# EasyEDA Pro project kuafu01_030内部老化方案_4.eprj, board PCB4 (continued)
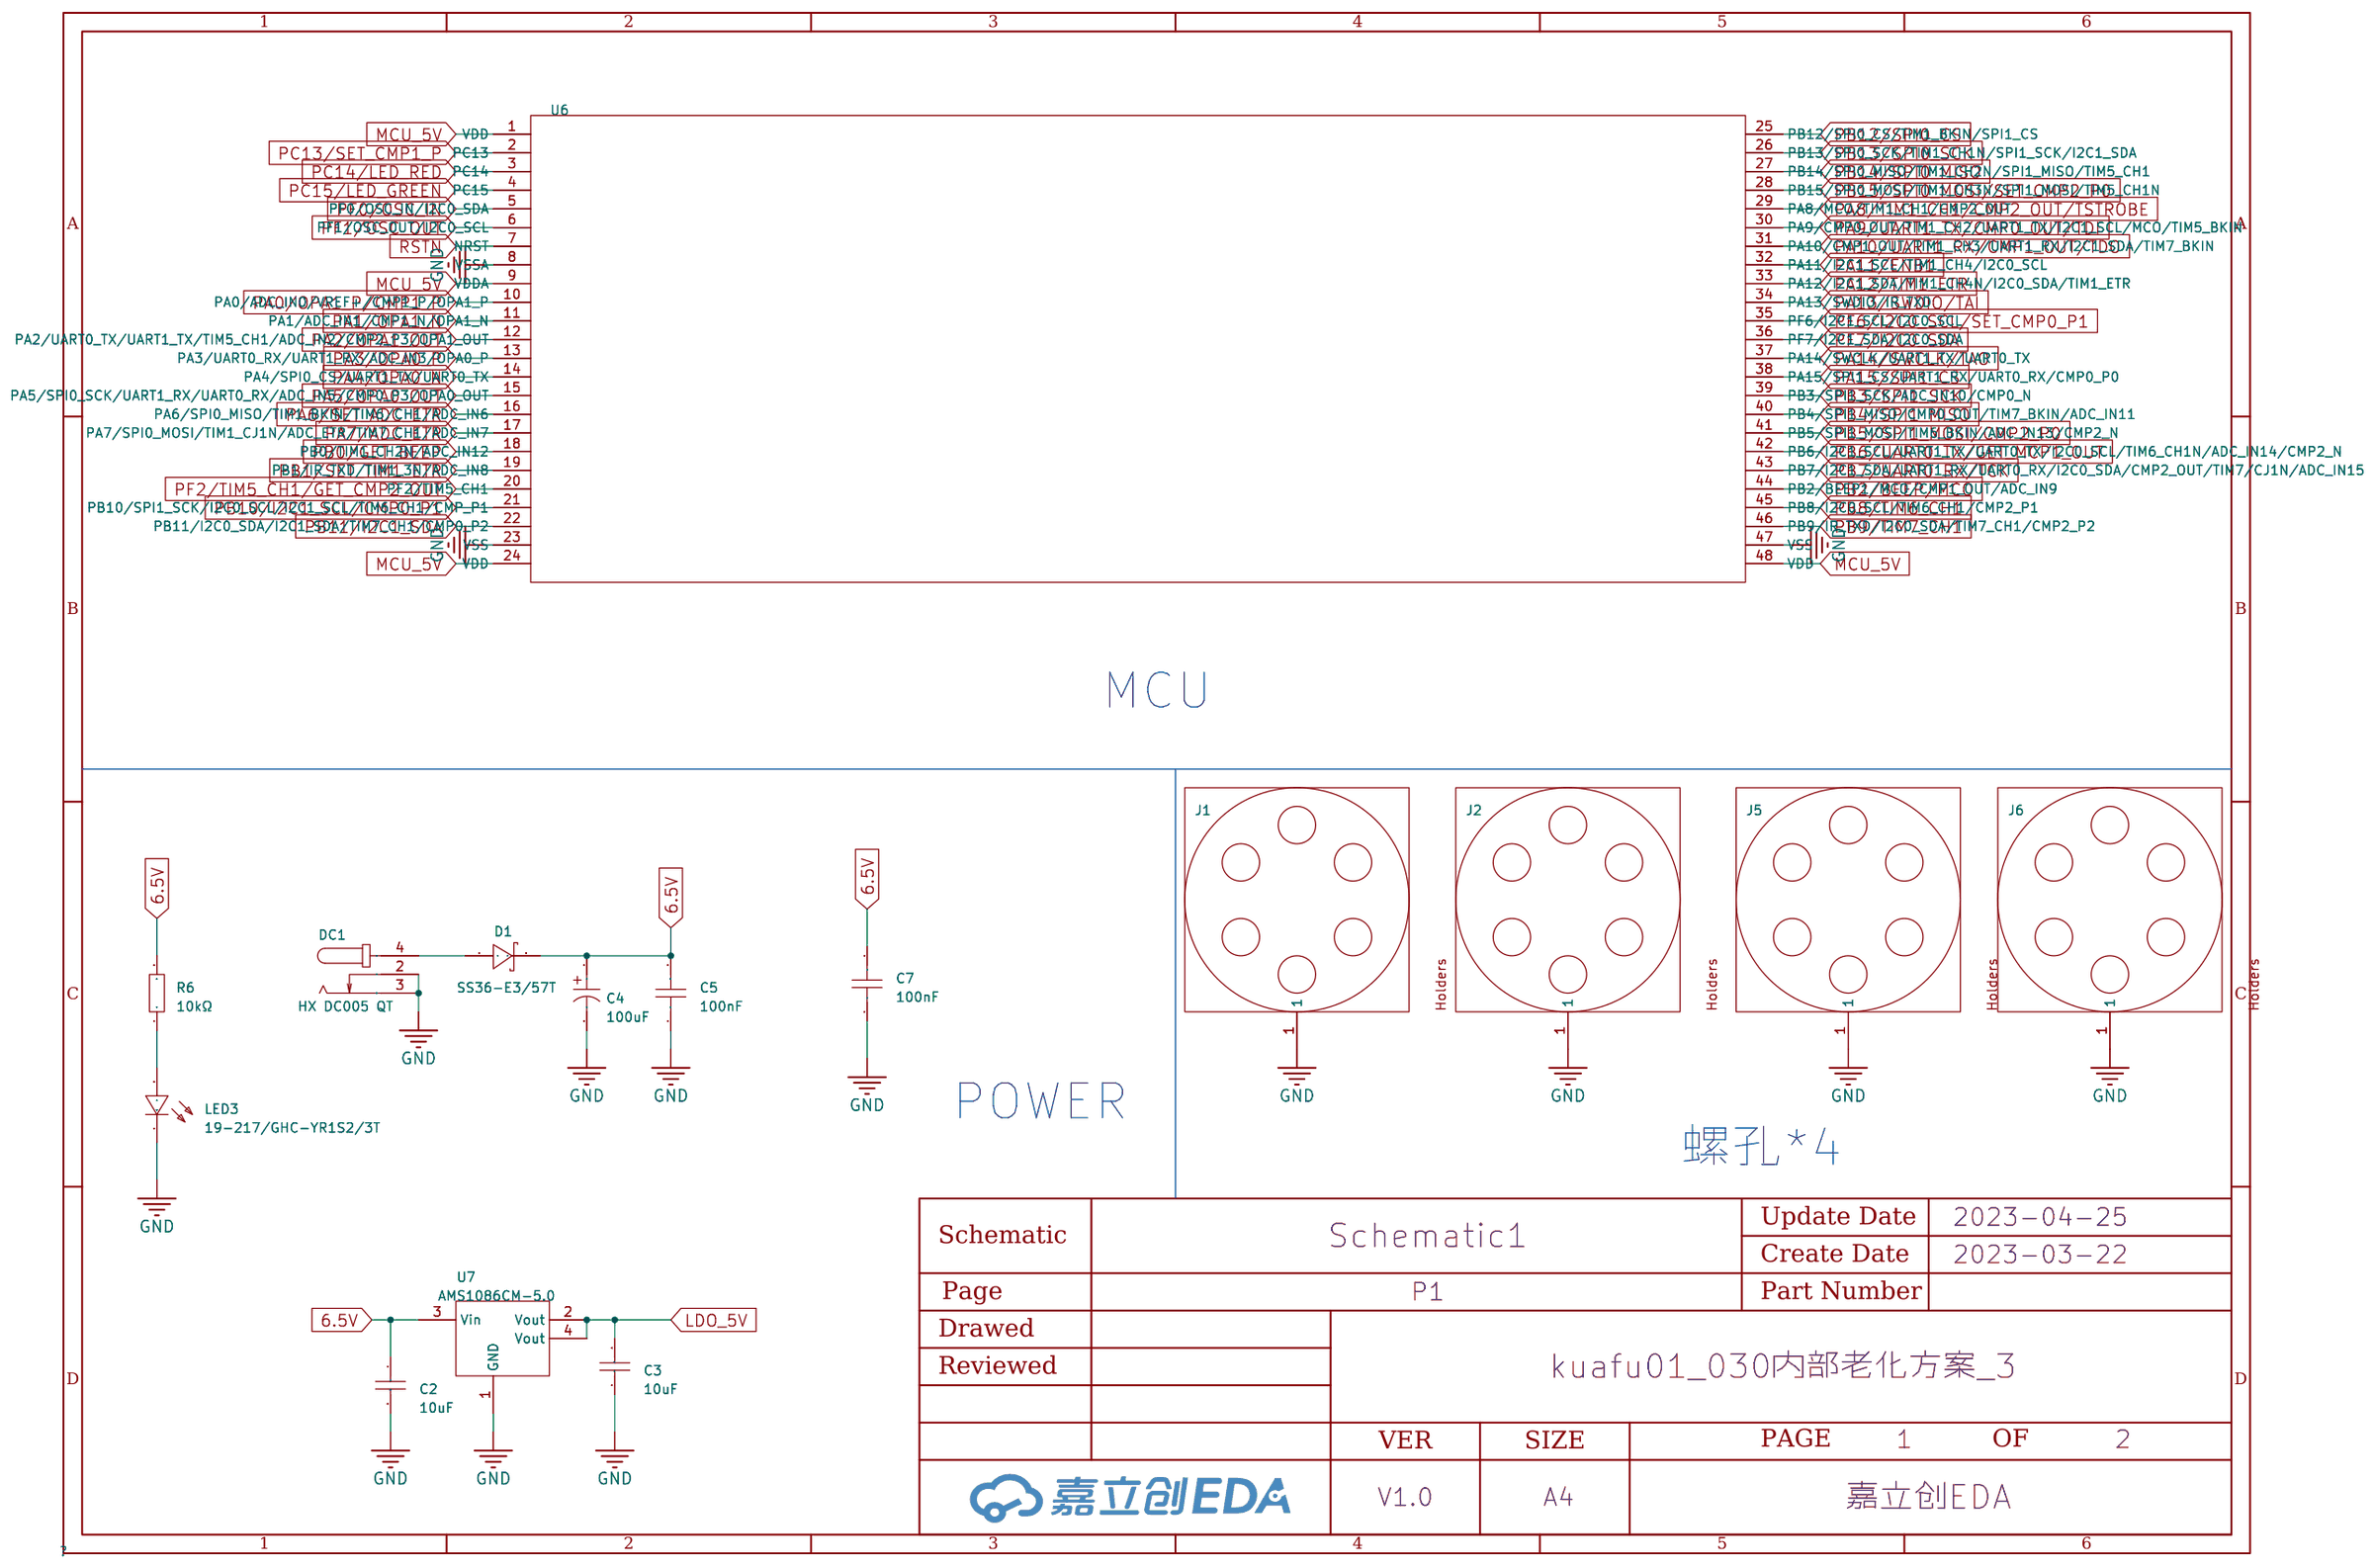
[diagram p0: P1]
## Routing (per net, layer and track width the routed paths; a pad name or vN(x,y) marks a point on that pad's centre or on a via; arc(x,y) is an arc through that point) (continued)
LDO_5V: length 2513.2
  Top Layer w0.5: H10.2 14.73,113.03 ; 14.73,113.03 62.99,113.03 65.28,110.74 H10#20.2 ; 14.73,113.03 1.53,113.03 ; 1.52,225.88 1.52,255.52 9.4,263.4 14.73,263.4 ; 1.52,225.88 1.52,188.18 ; 1.52,225.88 1.6,225.81 14.73,225.81 ; 1.52,150.62 1.52,188.18 ; 1.52,150.62 14.73,150.62 ; 1.52,150.62 1.52,75.43 ; 1.52,188.18 1.56,188.21 14.73,188.21 ; H10#27.2 216.92,263.4 ; 216.92,263.4 168.15,263.4 166.37,261.62 H10#26.2 ; 216.92,263.4 254.76,263.4 257.81,260.35 257.81,225.79 ; H10#12.2 115.82,185.93 113.54,188.21 65.28,188.21 ; 216.92,225.81 257.79,225.81 257.81,225.79 ; 216.92,225.81 H10#30.2 ; 216.92,225.81 167.64,225.81 166.37,224.54 H10#32.2 ; 216.92,37.59 253.75,37.59 257.81,41.66 257.81,75.45 ; 216.92,37.59 H10#24.2 ; 216.92,37.59 156.97,37.59 153.16,33.78 153.16,17.89 C3#2.2 153.06,17.78 U7#2.4 U7#2.2 ; H10#31.2 115.82,223.27 113.28,225.81 65.28,225.81 ; 216.92,75.44 257.8,75.44 257.81,75.45 ; 216.92,75.44 166.37,75.44 ; 216.92,75.44 H10#17.2 ; H10#10.2 216.92,188.21 ; 216.92,188.21 168.66,188.21 166.37,185.93 H10#13.2 ; 216.92,188.21 257.78,188.21 257.81,188.18 ; 14.73,37.85 7.11,37.85 1.52,43.43 1.52,75.43 ; 14.73,37.85 H10#23.2 ; 14.73,37.85 117.09,37.85 123.44,31.5 123.44,17.61 C3.2 123.46,17.57 U7.2 ; 216.92,113.03 257.78,113.03 257.81,113 ; 216.92,113.03 166.37,113.03 ; 216.92,113.03 H10#19.2 ; H10#3.2 65.28,263.4 ; 65.28,263.4 14.73,263.4 ; 65.28,263.4 113.54,263.4 115.82,261.11 H10#14.2 ; 166.37,75.44 118.11,75.44 115.82,73.15 H10#15.2 ; 166.37,75.44 H10#18.2 ; H10#21.2 115.82,111.51 117.35,113.03 166.37,113.03 ; 166.37,150.62 118.11,150.62 115.82,148.34 H10#6.2 ; 166.37,150.62 216.92,150.62 ; 166.37,150.62 H10#9.2 ; 14.73,75.44 1.54,75.44 1.52,75.43 ; 14.73,75.44 H10#2.2 ; 14.73,75.44 61.72,75.44 65.28,71.88 H10#16.2 ; 166.37,113.03 H10#22.2 ; 14.73,150.62 H10#5.2 ; 14.73,150.62 63.5,150.62 65.28,148.84 H10#7.2 ; 257.81,113 257.81,75.45 ; 257.81,113 257.81,150.5 ; 257.81,225.79 257.81,188.18 ; 14.73,188.21 H10#4.2 ; 14.73,188.21 65.28,188.21 ; 257.81,188.18 257.81,150.5 ; 257.81,150.5 257.68,150.62 216.92,150.62 ; H10#11.2 65.28,188.21 ; H10#29.2 14.73,225.81 ; 14.73,225.81 65.28,225.81 ; H10#28.2 65.28,225.81 ; 216.92,150.62 H10#8.2 ; 14.73,263.4 H10#25.2
MCU_5V: length 2294.3
  Top Layer w0.28: v2(136.25,81.65) 136.25,82.97 135.92,83.29 U6#19.24 ; v2(35.15,156.83) 35.15,158.15 34.83,158.47 U6#9.24 ; U6#3.48 26.55,130.81 24.84,130.81 ; 127.73,86.24 126.77,86.24 v2(125.93,85.4) ; 24.84,55.63 24.84,55.62 v2(24.84,53.19) 25.24,53.19 25.79,52.65 26.63,52.65 ; 24.84,55.63 26.55,55.63 U6#14.48 ; 24.84,55.63 H9#2.2 ; U6#7.24 186.47,120.88 186.79,120.56 v2(186.79,119.24) ; U6#6.48 228.74,168.4 227.02,168.4 ; 127.73,127.83 126.88,127.83 126.33,128.38 v2(125.94,128.38) 125.94,130.81 125.93,130.81 ; 176.48,93.22 176.48,93.21 v2(176.48,90.79) 176.88,90.79 177.42,90.24 U6#21.1 ; 176.48,93.22 H9#22.2 ; 176.48,93.22 178.19,93.22 U6#21.48 ; 75.38,168.4 75.39,168.4 v2(75.39,165.97) 75.79,165.97 76.33,165.42 U6#11.1 ; 75.38,168.4 77.1,168.4 U6#11.48 ; 75.38,168.4 H9#10.2 ; v2(237.34,156.83) 237.34,158.15 237.01,158.47 U6#6.24 ; v2(125.93,47.8) 126.77,48.65 127.73,48.65 ; v2(136.25,232.01) 136.25,233.33 135.92,233.66 U6#12.24 ; U6#5.24 85.38,120.88 85.7,120.56 v2(85.7,119.24) ; v2(227.02,122.99) 227.86,123.83 228.82,123.83 ; U6#30.48 127.65,205.99 125.93,205.99 ; 75.38,55.63 75.39,55.62 v2(75.39,53.19) 75.79,53.19 76.33,52.65 U6#16.1 ; 75.38,55.63 77.1,55.63 U6#16.48 ; 75.38,55.63 H9#16.2 ; 75.38,243.59 H9#3.2 ; 75.38,243.59 75.39,243.58 v2(75.39,241.15) 75.79,241.15 76.33,240.61 U6.1 ; 75.38,243.59 77.1,243.59 U6.48 ; 127.73,236.61 126.77,236.61 v2(125.93,235.76) ; 127.73,90.24 126.88,90.24 126.33,90.79 v2(125.94,90.79) 125.94,93.21 125.93,93.22 ; U6#4.48 228.74,130.81 227.02,130.81 ; U6#20.48 26.55,93.22 24.84,93.22 ; 125.93,55.63 H9#15.2 ; 125.93,55.63 127.65,55.63 U6#13.48 ; 125.93,55.63 125.94,55.62 v2(125.94,53.19) 126.33,53.19 126.88,52.65 127.73,52.65 ; 227.02,93.22 H9#18.2 ; 227.02,93.22 228.74,93.22 U6#17.48 ; 227.02,93.22 227.03,93.21 v2(227.03,90.79) 227.42,90.79 227.97,90.24 228.82,90.24 ; U6#2.24 135.92,120.88 136.25,120.56 v2(136.25,119.24) ; U6#21.9 177.32,86.24 v2(176.47,85.4) ; U6#18.24 186.47,45.7 186.79,45.37 v2(186.79,44.05) ; v2(85.7,194.42) 85.7,195.74 85.38,196.07 U6#29.24 ; 227.02,18.03 228.74,18.03 U6#24.48 ; 227.02,18.03 H9#24.2 ; 227.02,18.03 227.03,18.03 v2(227.03,15.6) 227.42,15.6 227.97,15.06 228.82,15.06 ; 176.48,55.63 176.48,55.62 v2(176.48,53.19) 176.88,53.19 177.42,52.65 U6#18.1 ; 176.48,55.63 H9#20.2 ; 176.48,55.63 178.19,55.63 U6#18.48 ; U6#7.9 177.32,123.83 v2(176.47,122.99) ; 228.82,11.06 227.86,11.06 v2(227.02,10.21) ; 24.84,93.22 24.84,93.21 v2(24.84,90.79) 25.24,90.79 25.79,90.24 26.63,90.24 ; 24.84,93.22 H9.2 ; 24.84,205.99 26.55,205.99 U6#31.48 ; 24.84,205.99 H9#29.2 ; 24.84,205.99 24.84,205.99 v2(24.84,203.56) 25.24,203.56 25.79,203.02 26.63,203.02 ; U6#7.1 177.42,127.83 176.88,128.38 v2(176.48,128.38) 176.48,130.81 176.48,130.81 ; U6#27.48 26.55,243.59 24.84,243.59 ; U6#11.24 85.38,158.47 85.7,158.15 v2(85.7,156.83) ; v2(125.93,160.58) 126.77,161.42 127.73,161.42 ; 75.38,93.22 H9#19.2 ; 75.38,93.22 77.1,93.22 U6#22.48 ; 75.38,93.22 75.39,93.21 v2(75.39,90.79) 75.79,90.79 76.33,90.24 U6#22.1 ; v2(227.02,85.4) 227.86,86.24 228.82,86.24 ; U6#29.1 76.33,203.02 75.79,203.56 v2(75.39,203.56) 75.39,205.99 75.38,205.99 ; U6#30.24 135.92,196.07 136.25,195.74 v2(136.25,194.42) ; 24.84,243.59 24.84,243.58 v2(24.84,241.15) 25.24,241.15 25.79,240.61 26.63,240.61 ; 24.84,243.59 H9#25.2 ; 125.93,205.99 125.94,205.99 v2(125.94,203.56) 126.33,203.56 126.88,203.02 127.73,203.02 ; 125.93,205.99 H9#31.2 ; 24.84,168.4 H9#4.2 ; 24.84,168.4 26.55,168.4 U6#9.48 ; 24.84,168.4 24.84,168.4 v2(24.84,165.97) 25.24,165.97 25.79,165.42 26.63,165.42 ; v2(24.83,47.8) 25.68,48.65 26.63,48.65 ; 176.48,130.81 H9#11.2 ; 176.48,130.81 178.19,130.81 U6#7.48 ; v2(237.34,232.01) 237.34,233.33 237.01,233.66 U6#26.24 ; v2(227.02,235.76) 227.86,236.61 228.82,236.61 ; v2(35.15,194.42) 35.15,195.74 34.83,196.07 U6#31.24 ; U6#13.24 135.92,45.7 136.25,45.37 v2(136.25,44.05) ; 228.82,240.61 227.97,240.61 227.42,241.15 v2(227.03,241.15) 227.03,243.58 227.02,243.59 ; U6#28.24 237.01,196.07 237.34,195.74 v2(237.34,194.42) ; U6#16.24 85.38,45.7 85.7,45.37 v2(85.7,44.05) ; v2(24.83,160.58) 25.68,161.42 26.63,161.42 ; 125.93,243.59 127.65,243.59 U6#12.48 ; 125.93,243.59 125.94,243.58 v2(125.94,241.15) 126.33,241.15 126.88,240.61 127.73,240.61 ; 125.93,243.59 H9#14.2 ; U6#5.9 76.22,123.83 v2(75.38,122.99) ; U6#10.1 177.42,165.42 176.88,165.97 v2(176.48,165.97) 176.48,168.4 176.48,168.4 ; U6#32.9 177.32,199.02 v2(176.47,198.17) ; 227.02,130.81 H9#8.2 ; 227.02,130.81 227.03,130.81 v2(227.03,128.38) 227.42,128.38 227.97,127.83 228.82,127.83 ; v2(227.02,47.8) 227.86,48.65 228.82,48.65 ; 24.84,130.81 24.84,130.81 v2(24.84,128.38) 25.24,128.38 25.79,127.83 26.63,127.83 ; 24.84,130.81 H9#5.2 ; 227.02,55.63 227.03,55.62 v2(227.03,53.19) 227.42,53.19 227.97,52.65 228.82,52.65 ; 227.02,55.63 H9#17.2 ; 227.02,55.63 228.74,55.63 U6#15.48 ; 227.02,243.59 H9#27.2 ; 227.02,243.59 228.74,243.59 U6#26.48 ; U6#25.24 186.47,233.66 186.79,233.33 v2(186.79,232.01) ; 75.38,205.99 H9#28.2 ; 75.38,205.99 77.1,205.99 U6#29.48 ; U6#5.1 76.33,127.83 75.79,128.38 v2(75.39,128.38) 75.39,130.81 75.38,130.81 ; v2(125.93,198.17) 126.77,199.02 127.73,199.02 ; v2(75.38,85.4) 76.22,86.24 U6#22.9 ; 75.38,130.81 77.1,130.81 U6#5.48 ; 75.38,130.81 H9#7.2 ; U6#17.24 237.01,83.29 237.34,82.97 v2(237.34,81.65) ; 127.73,165.42 126.88,165.42 126.33,165.97 v2(125.94,165.97) 125.94,168.4 125.93,168.4 ; 24.84,18.03 24.84,18.03 v2(24.84,15.6) 25.24,15.6 25.79,15.06 26.63,15.06 ; 24.84,18.03 H9#23.2 ; 24.84,18.03 26.55,18.03 U6#23.48 ; 176.48,243.59 176.48,243.58 v2(176.48,241.15) 176.88,241.15 177.42,240.61 U6#25.1 ; 176.48,243.59 H9#26.2 ; 176.48,243.59 178.19,243.59 U6#25.48 ; v2(176.47,235.76) 177.32,236.61 U6#25.9 ; U6#27.24 34.83,233.66 35.15,233.33 v2(35.15,232.01) ; v2(24.83,10.21) 25.68,11.06 26.63,11.06 ; v2(75.38,47.8) 76.22,48.65 U6#16.9 ; v2(237.34,44.05) 237.34,45.37 237.01,45.7 U6#15.24 ; U6#10.48 178.19,168.4 176.48,168.4 ; 228.82,203.02 227.97,203.02 227.42,203.56 v2(227.03,203.56) 227.03,205.99 227.02,205.99 ; v2(125.93,122.99) 126.77,123.83 127.73,123.83 ; 227.02,205.99 228.74,205.99 U6#28.48 ; 227.02,205.99 H9#30.2 ; U6#10.24 186.47,158.47 186.79,158.15 v2(186.79,156.83) ; 228.82,161.42 227.86,161.42 v2(227.02,160.58) ; 125.93,168.4 H9#12.2 ; 125.93,168.4 127.65,168.4 U6#8.48 ; 125.93,130.81 127.65,130.81 U6#2.48 ; 125.93,130.81 H9#6.2 ; 125.93,93.22 127.65,93.22 U6#19.48 ; 125.93,93.22 H9#21.2 ; 26.63,86.24 25.68,86.24 v2(24.83,85.4) ; U6#10.9 177.32,161.42 v2(176.47,160.58) ; v2(186.79,194.42) 186.79,195.74 186.47,196.07 U6#32.24 ; v2(85.7,81.65) 85.7,82.97 85.38,83.29 U6#22.24 ; 228.82,199.02 227.86,199.02 v2(227.02,198.17) ; U6#29.9 76.22,199.02 v2(75.38,198.17) ; U6#8.24 135.92,158.47 136.25,158.15 v2(136.25,156.83) ; 176.48,168.4 H9#13.2 ; v2(24.83,198.17) 25.68,199.02 26.63,199.02 ; v2(75.38,235.76) 76.22,236.61 U6.9 ; v2(35.15,44.05) 35.15,45.37 34.83,45.7 U6#14.24 ; v2(75.38,160.58) 76.22,161.42 U6#11.9 ; v2(237.34,6.46) 237.34,7.78 237.01,8.11 U6#24.24 ; v2(24.83,122.99) 25.68,123.83 26.63,123.83 ; U6#21.24 186.47,83.29 186.79,82.97 v2(186.79,81.65) ; 26.63,236.61 25.68,236.61 v2(24.83,235.76) ; U6#23.24 34.83,8.11 35.15,7.78 v2(35.15,6.46) ; U6.24 85.38,233.66 85.7,233.33 v2(85.7,232.01) ; 227.02,168.4 227.03,168.4 v2(227.03,165.97) 227.42,165.97 227.97,165.42 228.82,165.42 ; 227.02,168.4 H9#9.2 ; v2(237.34,119.24) 237.34,120.56 237.01,120.88 U6#4.24 ; U6#32.1 177.42,203.02 176.88,203.56 v2(176.48,203.56) 176.48,205.99 176.48,205.99 ; v2(35.15,81.65) 35.15,82.97 34.83,83.29 U6#20.24 ; U6#3.24 34.83,120.88 35.15,120.56 v2(35.15,119.24) ; 176.48,205.99 178.19,205.99 U6#32.48 ; 176.48,205.99 H9#32.2 ; v2(176.47,47.8) 177.32,48.65 U6#18.9
  Top Layer w0.5: v2(175.7,46.92) 175.7,47.03 v2(176.47,47.8) ; v2(125.16,159.7) 125.16,159.81 v2(125.93,160.58) ; CN1#24.4 28.19,257.36 CN2#25.1 19.23,258.57 17.27,256.61 H10#25.1 H9#25.2 ; v2(125.16,84.52) 125.16,84.63 v2(125.93,85.4) ; v2(75.38,85.4) 74.61,84.63 v2(74.61,84.52) ; CN1#21.4 179.83,69.4 CN2#21.1 170.87,70.61 168.91,68.65 H10#18.1 H9#20.2 ; v2(24.06,122.11) 24.06,122.22 v2(24.83,122.99) ; v2(24.06,197.29) 24.06,197.4 v2(24.83,198.17) ; CN1#19.4 129.29,69.4 CN2#14.1 120.33,70.61 118.36,68.65 H10#15.1 H9#15.2 ; H9#24.2 H10#24.1 219.46,31.06 221.42,33.02 CN2#24.1 230.38,31.81 CN1#23.4 ; H9#19.2 H10#20.1 67.82,106.24 69.78,108.2 CN2#20.1 78.74,106.99 CN1#20.4 ; v2(226.25,159.7) 226.25,159.81 v2(227.02,160.58) ; H9#26.2 H10#26.1 168.91,256.61 170.87,258.57 CN2#22.1 179.83,257.36 CN1#25.4 ; H9#28.2 H10#28.1 67.82,219.02 69.78,220.98 CN2#32.1 78.74,219.77 CN1#30.4 ; H9#23.2 H10#23.1 17.27,31.06 19.23,33.02 CN2#23.1 28.19,31.81 CN1#22.4 ; CN1#11.4 129.29,257.36 CN2#11.1 120.33,258.57 118.36,256.61 H10#14.1 H9#14.2 ; H9#4.2 H10#4.1 17.27,181.43 19.23,183.39 CN2#6.1 28.19,182.18 CN1#3.4 ; H9#7.2 H10#7.1 67.82,143.83 69.78,145.8 CN2#5.1 78.74,144.59 CN1#5.4 ; v2(125.16,122.11) 125.16,122.22 v2(125.93,122.99) ; CN1#9.4 78.74,182.18 CN2#9.1 69.78,183.39 67.82,181.43 H10#11.1 H9#10.2 ; v2(175.7,197.29) 175.7,197.4 v2(176.47,198.17) ; H9#3.2 H10#3.1 67.82,256.61 69.78,258.57 CN2#27.1 78.74,257.36 CN1#32.4 ; CN1#17.4 230.38,106.99 CN2#18.1 221.42,108.2 219.46,106.24 H10#19.1 H9#18.2 ; v2(227.02,235.76) 226.25,234.99 v2(226.25,234.88) ; v2(24.06,159.7) 24.06,159.81 v2(24.83,160.58) ; v2(227.02,122.99) 226.25,122.22 v2(226.25,122.11) ; v2(74.61,234.88) 74.61,234.99 v2(75.38,235.76) ; CN1#10.4 179.83,144.59 CN2#10.1 170.87,145.8 168.91,143.83 H10#9.1 H9#11.2 ; CN1#29.4 230.38,219.77 CN2#30.1 221.42,220.98 219.46,219.02 H10#30.1 H9#30.2 ; H9#21.2 H10#21.1 118.36,106.24 120.33,108.2 CN2#19.1 129.29,106.99 CN1#18.4 ; v2(24.83,235.76) 24.06,234.99 v2(24.06,234.88) ; v2(125.93,198.17) 125.16,197.4 v2(125.16,197.29) ; v2(227.02,198.17) 226.25,197.4 v2(226.25,197.29) ; H9.2 H10.1 17.27,106.24 19.23,108.2 CN2#17.1 28.19,106.99 CN1#14.4 ; v2(75.38,198.17) 74.61,197.4 v2(74.61,197.29) ; H9#13.2 H10#13.1 168.91,181.43 170.87,183.39 CN2#4.1 179.83,182.18 CN1#2.4 ; v2(125.16,234.88) 125.16,234.99 v2(125.93,235.76) ; H9#2.2 H10#2.1 17.27,68.65 19.23,70.61 CN2#12.1 28.19,69.4 CN1#15.4 ; v2(175.7,159.7) 175.7,159.81 v2(176.47,160.58) ; v2(175.7,122.11) 175.7,122.22 v2(176.47,122.99) ; CN1#26.4 230.38,257.36 CN2#26.1 221.42,258.57 219.46,256.61 H10#27.1 H9#27.2 ; v2(176.47,85.4) 175.7,84.63 v2(175.7,84.52) ; v2(74.61,122.11) 74.61,122.22 v2(75.38,122.99) ; CN1#8.4 129.29,144.59 CN2#3.1 120.33,145.8 118.36,143.83 H10#6.1 H9#6.2 ; H9#5.2 H10#5.1 17.27,143.83 19.23,145.8 CN2.1 28.19,144.59 CN1#4.4 ; v2(175.7,234.88) 175.7,234.99 v2(176.47,235.76) ; v2(74.61,159.7) 74.61,159.81 v2(75.38,160.58) ; CN1#16.4 78.74,69.4 CN2#16.1 69.78,70.61 67.82,68.65 H10#16.1 H9#16.2 ; v2(125.93,47.8) 125.16,47.03 v2(125.16,46.92) ; v2(226.25,9.33) 226.25,9.44 v2(227.02,10.21) ; CN1#28.4 179.83,219.77 CN2#29.1 170.87,220.98 168.91,219.02 H10#32.1 H9#32.2 ; H9#9.2 H10#10.1 219.46,181.43 221.42,183.39 CN2#7.1 230.38,182.18 CN1#6.4 ; H9#8.2 H10#8.1 219.46,143.83 221.42,145.8 CN2#2.1 230.38,144.59 CN1.4 ; CN1#31.4 129.29,219.77 CN2#31.1 120.33,220.98 118.36,219.02 H10#31.1 H9#31.2 ; CN1#12.4 230.38,69.4 CN2#13.1 221.42,70.61 219.46,68.65 H10#17.1 H9#17.2 ; CN1#7.4 129.29,182.18 CN2#8.1 120.33,183.39 118.36,181.43 H10#12.1 H9#12.2 ; v2(227.02,47.8) 226.25,47.03 v2(226.25,46.92) ; H9#22.2 H10#22.1 168.91,106.24 170.87,108.2 CN2#15.1 179.83,106.99 CN1#13.4 ; v2(24.06,9.33) 24.06,9.44 v2(24.83,10.21) ; CN1#27.4 28.19,219.77 CN2#28.1 19.23,220.98 17.27,219.02 H10#29.1 H9#29.2 ; v2(75.38,47.8) 74.61,47.03 v2(74.61,46.92) ; v2(24.06,84.52) 24.06,84.63 v2(24.83,85.4) ; v2(24.06,46.92) 24.06,47.03 v2(24.83,47.8) ; v2(226.25,84.52) 226.25,84.63 v2(227.02,85.4)
  Bottom Layer w0.28: v2(125.94,90.79) 125.93,90.78 v2(125.93,85.4) ; v2(75.39,203.56) 75.38,203.55 v2(75.38,198.17) ; v2(125.93,198.17) 125.93,203.55 v2(125.94,203.56) ; v2(75.39,90.79) 75.38,90.78 v2(75.38,85.4) ; v2(75.38,235.76) 75.38,241.14 v2(75.39,241.15) ; v2(24.83,160.58) 24.83,165.96 v2(24.84,165.97) ; v2(227.02,122.99) 227.02,128.37 v2(227.03,128.38) ; v2(24.83,122.99) 24.83,128.37 v2(24.84,128.38) ; v2(176.47,47.8) 176.47,53.18 v2(176.48,53.19) ; v2(176.48,128.38) 176.47,128.37 v2(176.47,122.99) ; v2(176.48,90.79) 176.47,90.78 v2(176.47,85.4) ; v2(176.48,165.97) 176.47,165.96 v2(176.47,160.58) ; v2(227.02,10.21) 227.02,15.59 v2(227.03,15.6) ; v2(24.84,241.15) 24.83,241.14 v2(24.83,235.76) ; v2(176.48,203.56) 176.47,203.55 v2(176.47,198.17) ; v2(24.84,90.79) 24.83,90.78 v2(24.83,85.4) ; v2(125.93,122.99) 125.93,128.37 v2(125.94,128.38) ; v2(24.84,15.6) 24.83,15.59 v2(24.83,10.21) ; v2(75.38,160.58) 75.38,165.96 v2(75.39,165.97) ; v2(75.38,122.99) 75.38,128.37 v2(75.39,128.38) ; v2(75.38,47.8) 75.38,53.18 v2(75.39,53.19) ; v2(227.03,53.19) 227.02,53.18 v2(227.02,47.8) ; v2(24.84,203.56) 24.83,203.55 v2(24.83,198.17) ; v2(227.02,160.58) 227.02,165.96 v2(227.03,165.97) ; v2(24.84,53.19) 24.83,53.18 v2(24.83,47.8) ; v2(125.94,53.19) 125.93,53.18 v2(125.93,47.8) ; v2(125.93,160.58) 125.93,165.96 v2(125.94,165.97) ; v2(176.48,241.15) 176.47,241.14 v2(176.47,235.76) ; v2(227.03,203.56) 227.02,203.55 v2(227.02,198.17) ; v2(227.03,241.15) 227.02,241.14 v2(227.02,235.76) ; v2(227.03,90.79) 227.02,90.78 v2(227.02,85.4) ; v2(125.94,241.15) 125.93,241.14 v2(125.93,235.76)
  Bottom Layer w0.5: v2(85.7,194.42) 75.16,194.42 74.61,194.97 v2(74.61,197.29) ; v2(35.15,194.42) 24.61,194.42 24.06,194.97 v2(24.06,197.29) ; v2(74.61,122.11) 74.61,119.79 75.16,119.24 v2(85.7,119.24) ; v2(24.06,46.92) 24.06,44.6 24.61,44.05 v2(35.15,44.05) ; v2(237.34,6.46) 226.8,6.46 226.25,7.01 v2(226.25,9.33) ; v2(24.06,234.88) 24.06,232.56 24.61,232.01 v2(35.15,232.01) ; v2(226.25,122.11) 226.25,119.79 226.8,119.24 v2(237.34,119.24) ; v2(186.79,156.83) 176.25,156.83 175.7,157.38 v2(175.7,159.7) ; v2(136.25,156.83) 125.71,156.83 125.16,157.38 v2(125.16,159.7) ; v2(125.16,46.92) 125.16,44.6 125.71,44.05 v2(136.25,44.05) ; v2(237.34,156.83) 226.8,156.83 226.25,157.38 v2(226.25,159.7) ; v2(136.25,194.42) 125.71,194.42 125.16,194.97 v2(125.16,197.29) ; v2(226.25,84.52) 226.25,82.2 226.8,81.65 v2(237.34,81.65) ; v2(74.61,84.52) 74.61,82.2 75.16,81.65 v2(85.7,81.65) ; v2(74.61,234.88) 74.61,232.56 75.16,232.01 v2(85.7,232.01) ; v2(125.16,234.88) 125.16,232.56 125.71,232.01 v2(136.25,232.01) ; v2(24.06,159.7) 24.06,157.38 24.61,156.83 v2(35.15,156.83) ; v2(175.7,122.11) 175.7,119.79 176.25,119.24 v2(186.79,119.24) ; v2(136.25,119.24) 125.71,119.24 125.16,119.79 v2(125.16,122.11) ; v2(74.61,46.92) 74.61,44.6 75.16,44.05 v2(85.7,44.05) ; v2(237.34,194.42) 226.8,194.42 226.25,194.97 v2(226.25,197.29) ; v2(85.7,156.83) 75.16,156.83 74.61,157.38 v2(74.61,159.7) ; v2(24.06,122.11) 24.06,119.79 24.61,119.24 v2(35.15,119.24) ; v2(175.7,197.29) 175.7,194.97 176.25,194.42 v2(186.79,194.42) ; v2(186.79,81.65) 176.25,81.65 175.7,82.2 v2(175.7,84.52) ; v2(35.15,6.46) 24.61,6.46 24.06,7.01 v2(24.06,9.33) ; v2(237.34,44.05) 226.8,44.05 226.25,44.6 v2(226.25,46.92) ; v2(186.79,232.01) 176.25,232.01 175.7,232.56 v2(175.7,234.88) ; v2(24.06,84.52) 24.06,82.2 24.61,81.65 v2(35.15,81.65) ; v2(136.25,81.65) 125.71,81.65 125.16,82.2 v2(125.16,84.52) ; v2(175.7,46.92) 175.7,44.6 176.25,44.05 v2(186.79,44.05) ; v2(226.25,234.88) 226.25,232.56 226.8,232.01 v2(237.34,232.01)
PA0/OPA1_P/CMP1_P: length 371.3
  Top Layer w0.28: 168.91,233.17 176.28,233.17 177.18,234.07 177.18,235.83 177.46,236.11 U6#25.10 ; 228.82,160.92 228,160.92 227.72,160.64 227.72,158.89 226.82,157.99 219.46,157.99 ; 26.63,160.92 25.82,160.92 25.54,160.64 25.54,158.89 24.64,157.99 17.27,157.99 ; 67.82,120.4 75.18,120.4 76.09,121.3 76.09,123.05 76.37,123.33 U6#5.10 ; 17.27,7.62 24.64,7.62 25.54,8.52 25.54,10.28 25.82,10.56 26.63,10.56 ; U6#16.10 76.37,48.15 76.09,47.87 76.09,46.11 75.18,45.21 67.82,45.21 ; 219.46,82.8 226.82,82.8 227.72,83.71 227.72,85.46 228,85.74 228.82,85.74 ; 17.27,195.58 24.64,195.58 25.54,196.48 25.54,198.24 25.82,198.52 26.63,198.52 ; U6#11.10 76.37,160.92 76.09,160.64 76.09,158.89 75.18,157.99 67.82,157.99 ; 118.36,195.58 125.73,195.58 126.63,196.48 126.63,198.24 126.91,198.52 127.73,198.52 ; 127.73,48.15 126.91,48.15 126.63,47.87 126.63,46.11 125.73,45.21 118.36,45.21 ; U6.10 76.37,236.11 76.09,235.83 76.09,234.07 75.18,233.17 67.82,233.17 ; 219.46,195.58 226.82,195.58 227.72,196.48 227.72,198.24 228,198.52 228.82,198.52 ; U6#10.10 177.46,160.92 177.18,160.64 177.18,158.89 176.28,157.99 168.91,157.99 ; 118.36,157.99 125.73,157.99 126.63,158.89 126.63,160.64 126.91,160.92 127.73,160.92 ; 219.46,45.21 226.82,45.21 227.72,46.11 227.72,47.87 228,48.15 228.82,48.15 ; U6#18.10 177.46,48.15 177.18,47.87 177.18,46.11 176.28,45.21 168.91,45.21 ; 118.36,82.8 125.73,82.8 126.63,83.71 126.63,85.46 126.91,85.74 127.73,85.74 ; U6#21.10 177.46,85.74 177.18,85.46 177.18,83.71 176.28,82.8 168.91,82.8 ; 219.46,7.62 226.82,7.62 227.72,8.52 227.72,10.28 228,10.56 228.82,10.56 ; 17.27,45.21 24.64,45.21 25.54,46.11 25.54,47.87 25.82,48.15 26.63,48.15 ; 168.91,195.58 176.28,195.58 177.18,196.48 177.18,198.24 177.46,198.52 U6#32.10 ; 67.82,195.58 75.18,195.58 76.09,196.48 76.09,198.24 76.37,198.52 U6#29.10 ; 17.27,120.4 24.64,120.4 25.54,121.3 25.54,123.05 25.82,123.33 26.63,123.33 ; 168.91,120.4 176.28,120.4 177.18,121.3 177.18,123.05 177.46,123.33 U6#7.10 ; 118.36,120.4 125.73,120.4 126.63,121.3 126.63,123.05 126.91,123.33 127.73,123.33 ; 67.82,82.8 75.18,82.8 76.09,83.71 76.09,85.46 76.37,85.74 U6#22.10 ; 26.63,85.74 25.82,85.74 25.54,85.46 25.54,83.71 24.64,82.8 17.27,82.8 ; 219.46,120.4 226.82,120.4 227.72,121.3 227.72,123.05 228,123.33 228.82,123.33 ; 17.27,233.17 24.64,233.17 25.54,234.07 25.54,235.83 25.82,236.11 26.63,236.11 ; 228.82,236.11 228,236.11 227.72,235.83 227.72,234.07 226.82,233.17 219.46,233.17 ; 127.73,236.11 126.91,236.11 126.63,235.83 126.63,234.07 125.73,233.17 118.36,233.17
PA1/OPA1_N: length 16
  Top Layer w0.28: 228.82,47.65 228.82,47.15 ; 26.63,160.42 26.63,159.92 ; U6#25.11 U6#25.12 ; 127.73,160.42 127.73,159.92 ; 26.63,122.83 26.63,122.33 ; 228.82,235.61 228.82,235.11 ; 127.73,235.61 127.73,235.11 ; 228.82,160.42 228.82,159.92 ; U6#22.11 U6#22.12 ; 26.63,85.24 26.63,84.74 ; 26.63,10.06 26.63,9.56 ; 127.73,47.65 127.73,47.15 ; 127.73,122.83 127.73,122.33 ; U6.11 U6.12 ; 228.82,122.83 228.82,122.33 ; 228.82,85.24 228.82,84.74 ; U6#7.11 U6#7.12 ; U6#29.11 U6#29.12 ; 127.73,198.02 127.73,197.52 ; 26.63,47.65 26.63,47.15 ; U6#16.11 U6#16.12 ; 228.82,10.06 228.82,9.56 ; U6#11.11 U6#11.12 ; U6#10.11 U6#10.12 ; 228.82,198.02 228.82,197.52 ; 26.63,198.02 26.63,197.52 ; U6#18.11 U6#18.12 ; U6#32.11 U6#32.12 ; U6#5.11 U6#5.12 ; 127.73,85.24 127.73,84.74 ; 26.63,235.61 26.63,235.11 ; U6#21.11 U6#21.12
PA3/OPA0_P: length 399.3
  Top Layer w0.28: 118.36,155.45 118.74,155.45 120.66,157.36 128.77,157.36 129.17,157.77 U6#8.13 ; U6#23.13 28.08,7.4 27.67,6.99 19.56,6.99 17.65,5.08 17.27,5.08 ; U6#11.13 78.63,157.77 78.22,157.36 70.11,157.36 68.2,155.45 67.82,155.45 ; 17.27,230.63 17.65,230.63 19.56,232.54 27.67,232.54 28.08,232.95 U6#27.13 ; 118.36,42.67 118.74,42.67 120.66,44.58 128.77,44.58 129.17,44.99 U6#13.13 ; U6#18.13 179.72,44.99 179.31,44.58 171.2,44.58 169.29,42.67 168.91,42.67 ; U6#30.13 129.17,195.36 128.77,194.95 120.66,194.95 118.74,193.04 118.36,193.04 ; 168.91,80.26 169.29,80.26 171.2,82.18 179.31,82.18 179.72,82.58 U6#21.13 ; 67.82,193.04 68.2,193.04 70.11,194.95 78.22,194.95 78.63,195.36 U6#29.13 ; 67.82,80.26 68.2,80.26 70.11,82.18 78.22,82.18 78.63,82.58 U6#22.13 ; 17.27,42.67 17.65,42.67 19.56,44.58 27.67,44.58 28.08,44.99 U6#14.13 ; U6#24.13 230.27,7.4 229.86,6.99 221.75,6.99 219.84,5.08 219.46,5.08 ; U6#10.13 179.72,157.77 179.31,157.36 171.2,157.36 169.29,155.45 168.91,155.45 ; 219.46,42.67 219.84,42.67 221.75,44.58 229.86,44.58 230.27,44.99 U6#15.13 ; 118.36,80.26 118.74,80.26 120.66,82.18 128.77,82.18 129.17,82.58 U6#19.13 ; 219.46,117.86 219.84,117.86 221.75,119.77 229.86,119.77 230.27,120.18 U6#4.13 ; 17.27,155.45 17.65,155.45 19.56,157.36 27.67,157.36 28.08,157.77 U6#9.13 ; 17.27,193.04 17.65,193.04 19.56,194.95 27.67,194.95 28.08,195.36 U6#31.13 ; U6.13 78.63,232.95 78.22,232.54 70.11,232.54 68.2,230.63 67.82,230.63 ; U6#2.13 129.17,120.18 128.77,119.77 120.66,119.77 118.74,117.86 118.36,117.86 ; 17.27,80.26 17.65,80.26 19.56,82.18 27.67,82.18 28.08,82.58 U6#20.13 ; U6#7.13 179.72,120.18 179.31,119.77 171.2,119.77 169.29,117.86 168.91,117.86 ; 168.91,193.04 169.29,193.04 171.2,194.95 179.31,194.95 179.72,195.36 U6#32.13 ; U6#26.13 230.27,232.95 229.86,232.54 221.75,232.54 219.84,230.63 219.46,230.63 ; U6#16.13 78.63,44.99 78.22,44.58 70.11,44.58 68.2,42.67 67.82,42.67 ; 118.36,230.63 118.74,230.63 120.66,232.54 128.77,232.54 129.17,232.95 U6#12.13 ; U6#25.13 179.72,232.95 179.31,232.54 171.2,232.54 169.29,230.63 168.91,230.63 ; U6#6.13 230.27,157.77 229.86,157.36 221.75,157.36 219.84,155.45 219.46,155.45 ; 17.27,117.86 17.65,117.86 19.56,119.77 27.67,119.77 28.08,120.18 U6#3.13 ; 219.46,193.04 219.84,193.04 221.75,194.95 229.86,194.95 230.27,195.36 U6#28.13 ; U6#17.13 230.27,82.58 229.86,82.18 221.75,82.18 219.84,80.26 219.46,80.26 ; 67.82,117.86 68.2,117.86 70.11,119.77 78.22,119.77 78.63,120.18 U6#5.13
PA4/OPA0_N: length 16
  Top Layer w0.28: 180.22,196.07 U6#32.15 ; U6#19.14 U6#19.15 ; U6#20.14 U6#20.15 ; U6#14.14 U6#14.15 ; U6#24.14 U6#24.15 ; 180.22,120.88 U6#7.15 ; U6#3.14 U6#3.15 ; U6#27.14 U6#27.15 ; U6#6.14 U6#6.15 ; 180.22,83.29 U6#21.15 ; 79.13,83.29 U6#22.15 ; 79.13,196.07 U6#29.15 ; U6#9.14 U6#9.15 ; 180.22,158.47 U6#10.15 ; U6#30.14 U6#30.15 ; U6#28.14 U6#28.15 ; U6#12.14 U6#12.15 ; 79.13,158.47 U6#11.15 ; U6#15.14 U6#15.15 ; 79.13,233.66 U6.15 ; 79.13,45.7 U6#16.15 ; 180.22,45.7 U6#18.15 ; 180.22,233.66 U6#25.15 ; U6#26.14 U6#26.15 ; U6#8.14 U6#8.15 ; U6#2.14 U6#2.15 ; U6#23.14 U6#23.15 ; U6#4.14 U6#4.15 ; U6#17.14 U6#17.15 ; U6#13.14 U6#13.15 ; U6#31.14 U6#31.15 ; 79.13,120.88 U6#5.15
PA6/SET_ADC_ETR: length 16
  Top Layer w0.28: U6#26.16 U6#26.17 ; U6#20.16 U6#20.17 ; 181.22,83.29 U6#21.17 ; 181.22,45.7 U6#18.17 ; U6#31.16 U6#31.17 ; U6#6.16 U6#6.17 ; U6#27.16 U6#27.17 ; U6#2.16 U6#2.17 ; U6#30.16 U6#30.17 ; U6#13.16 U6#13.17 ; U6#19.16 U6#19.17 ; 80.13,158.47 U6#11.17 ; U6#23.16 U6#23.17 ; U6#8.16 U6#8.17 ; 181.22,158.47 U6#10.17 ; 181.22,120.88 U6#7.17 ; 181.22,196.07 U6#32.17 ; 80.13,120.88 U6#5.17 ; U6#15.16 U6#15.17 ; U6#3.16 U6#3.17 ; U6#14.16 U6#14.17 ; 80.13,233.66 U6.17 ; U6#24.16 U6#24.17 ; U6#12.16 U6#12.17 ; U6#4.16 U6#4.17 ; U6#17.16 U6#17.17 ; U6#28.16 U6#28.17 ; U6#9.16 U6#9.17 ; 80.13,196.07 U6#29.17 ; 80.13,83.29 U6#22.17 ; 181.22,233.66 U6#25.17 ; 80.13,45.7 U6#16.17
PA8/TIM1_CH1/CMP2_OUT/TSTROBE: length 1118.5
  Top Layer w0.28: H5#21.1 145.26,83.06 143.49,84.83 v1(143.49,86.25) 142.51,86.25 142.01,86.74 136.13,86.74 U6#19.29 ; CN1.7 235.46,135.92 235.68,135.7 241.77,135.7 242.73,136.66 v1(244.59,136.66) ; v1(244.59,99.07) 242.73,99.07 241.77,98.11 235.68,98.11 235.46,98.32 CN1#17.7 ; H5#2.1 145.26,120.65 143.49,122.42 v1(143.49,123.84) 142.51,123.84 142.01,124.34 136.13,124.34 U6#2.29 ; CN1#32.7 83.82,248.69 84.04,248.47 90.13,248.47 91.09,249.43 v1(92.95,249.43) ; H5#12.1 195.8,158.24 194.03,160.01 v1(194.03,161.43) 193.05,161.43 192.55,161.93 186.67,161.93 U6#10.29 ; v1(143.5,249.43) 141.63,249.43 140.67,248.47 134.58,248.47 134.37,248.69 CN1#11.7 ; v1(143.5,61.47) 141.63,61.47 140.67,60.51 134.58,60.51 134.37,60.73 CN1#19.7 ; CN1#9.7 83.82,173.51 84.04,173.29 90.13,173.29 91.09,174.25 v1(92.95,174.25) ; v1(42.4,99.07) 40.54,99.07 39.58,98.11 33.49,98.11 33.27,98.32 CN1#14.7 ; H5#28.1 246.35,195.83 244.58,197.61 v1(244.58,199.02) 243.6,199.02 243.1,199.52 237.22,199.52 U6#28.29 ; U6#14.29 35.04,49.15 40.92,49.15 41.41,48.65 v1(42.39,48.65) 42.39,47.24 44.17,45.47 H5#16.1 ; H5#13.1 145.26,45.47 143.49,47.24 v1(143.49,48.65) 142.51,48.65 142.01,49.15 136.13,49.15 U6#13.29 ; H5#25.1 195.8,233.43 194.03,235.2 v1(194.03,236.61) 193.05,236.61 192.55,237.11 186.67,237.11 U6#25.29 ; CN1#21.7 184.91,60.73 185.13,60.51 191.22,60.51 192.18,61.47 v1(194.04,61.47) ; v1(143.5,99.07) 141.63,99.07 140.67,98.11 134.58,98.11 134.37,98.32 CN1#18.7 ; H5#23.1 44.17,7.87 42.39,9.65 v1(42.39,11.06) 41.41,11.06 40.92,11.56 35.04,11.56 U6#23.29 ; CN1#26.7 235.46,248.69 235.68,248.47 241.77,248.47 242.73,249.43 v1(244.59,249.43) ; CN1#15.7 33.27,60.73 33.49,60.51 39.58,60.51 40.54,61.47 v1(42.4,61.47) ; v1(92.95,136.66) 91.09,136.66 90.13,135.7 84.04,135.7 83.82,135.92 CN1#5.7 ; CN1#12.7 235.46,60.73 235.68,60.51 241.77,60.51 242.73,61.47 v1(244.59,61.47) ; H5#17.1 246.35,45.47 244.58,47.24 v1(244.58,48.65) 243.6,48.65 243.1,49.15 237.22,49.15 U6#15.29 ; CN1#2.7 184.91,173.51 185.13,173.29 191.22,173.29 192.18,174.25 v1(194.04,174.25) ; H5#9.1 94.71,158.24 92.94,160.01 v1(92.94,161.43) 91.96,161.43 91.46,161.93 85.58,161.93 U6#11.29 ; v1(143.5,136.66) 141.63,136.66 140.67,135.7 134.58,135.7 134.37,135.92 CN1#8.7 ; v1(244.59,211.84) 242.73,211.84 241.77,210.88 235.68,210.88 235.46,211.1 CN1#29.7 ; CN1#6.7 235.46,173.51 235.68,173.29 241.77,173.29 242.73,174.25 v1(244.59,174.25) ; U6#31.29 35.04,199.52 40.92,199.52 41.41,199.02 v1(42.39,199.02) 42.39,197.61 44.17,195.83 H5#29.1 ; U6#29.29 85.58,199.52 91.46,199.52 91.96,199.02 v1(92.94,199.02) 92.94,197.61 94.71,195.83 H5#30.1 ; v1(194.04,211.84) 192.18,211.84 191.22,210.88 185.13,210.88 184.91,211.1 CN1#28.7 ; CN1#10.7 184.91,135.92 185.13,135.7 191.22,135.7 192.18,136.66 v1(194.04,136.66) ; U6#22.29 85.58,86.74 91.46,86.74 91.96,86.25 v1(92.94,86.25) 92.94,84.83 94.71,83.06 H5#20.1 ; CN1#16.7 83.82,60.73 84.04,60.51 90.13,60.51 91.09,61.47 v1(92.95,61.47) ; U6#20.29 35.04,86.74 40.92,86.74 41.41,86.25 v1(42.39,86.25) 42.39,84.83 44.17,83.06 H5#15.1 ; v1(42.4,174.25) 40.54,174.25 39.58,173.29 33.49,173.29 33.27,173.51 CN1#3.7 ; U6#4.29 237.22,124.34 243.1,124.34 243.6,123.84 v1(244.58,123.84) 244.58,122.42 246.35,120.65 H5#6.1 ; CN1#20.7 83.82,98.32 84.04,98.11 90.13,98.11 91.09,99.07 v1(92.95,99.07) ; H5#11.1 145.26,233.43 143.49,235.2 v1(143.49,236.61) 142.51,236.61 142.01,237.11 136.13,237.11 U6#12.29 ; v1(92.95,211.84) 91.09,211.84 90.13,210.88 84.04,210.88 83.82,211.1 CN1#30.7 ; H5.1 94.71,233.43 92.94,235.2 v1(92.94,236.61) 91.96,236.61 91.46,237.11 85.58,237.11 U6.29 ; U6#26.29 237.22,237.11 243.1,237.11 243.6,236.61 v1(244.58,236.61) 244.58,235.2 246.35,233.43 H5#27.1 ; H5#3.1 94.71,120.65 92.94,122.42 v1(92.94,123.84) 91.96,123.84 91.46,124.34 85.58,124.34 U6#5.29 ; H5#4.1 44.17,158.24 42.39,160.01 v1(42.39,161.43) 41.41,161.43 40.92,161.93 35.04,161.93 U6#9.29 ; H5#19.1 246.35,83.06 244.58,84.83 v1(244.58,86.25) 243.6,86.25 243.1,86.74 237.22,86.74 U6#17.29 ; H5#5.1 44.17,120.65 42.39,122.42 v1(42.39,123.84) 41.41,123.84 40.92,124.34 35.04,124.34 U6#3.29 ; H5#8.1 246.35,158.24 244.58,160.01 v1(244.58,161.43) 243.6,161.43 243.1,161.93 237.22,161.93 U6#6.29 ; H5#14.1 94.71,45.47 92.94,47.24 v1(92.94,48.65) 91.96,48.65 91.46,49.15 85.58,49.15 U6#16.29 ; U6#7.29 186.67,124.34 192.55,124.34 193.05,123.84 v1(194.03,123.84) 194.03,122.42 195.8,120.65 H5#7.1 ; v1(42.4,136.66) 40.54,136.66 39.58,135.7 33.49,135.7 33.27,135.92 CN1#4.7 ; H5#18.1 195.8,45.47 194.03,47.24 v1(194.03,48.65) 193.05,48.65 192.55,49.15 186.67,49.15 U6#18.29 ; U6#21.29 186.67,86.74 192.55,86.74 193.05,86.25 v1(194.03,86.25) 194.03,84.83 195.8,83.06 H5#22.1 ; CN1#23.7 235.46,23.14 235.68,22.92 241.77,22.92 242.73,23.88 v1(244.59,23.88) ; CN1#7.7 134.37,173.51 134.58,173.29 140.67,173.29 141.63,174.25 v1(143.5,174.25) ; CN1#25.7 184.91,248.69 185.13,248.47 191.22,248.47 192.18,249.43 v1(194.04,249.43) ; H5#24.1 246.35,7.87 244.58,9.65 v1(244.58,11.06) 243.6,11.06 243.1,11.56 237.22,11.56 U6#24.29 ; CN1#24.7 33.27,248.69 33.49,248.47 39.58,248.47 40.54,249.43 v1(42.4,249.43) ; H5#31.1 145.26,195.83 143.49,197.61 v1(143.49,199.02) 142.51,199.02 142.01,199.52 136.13,199.52 U6#30.29 ; v1(42.4,211.84) 40.54,211.84 39.58,210.88 33.49,210.88 33.27,211.1 CN1#27.7 ; U6#32.29 186.67,199.52 192.55,199.52 193.05,199.02 v1(194.03,199.02) 194.03,197.61 195.8,195.83 H5#32.1 ; CN1#13.7 184.91,98.32 185.13,98.11 191.22,98.11 192.18,99.07 v1(194.04,99.07) ; CN1#31.7 134.37,211.1 134.58,210.88 140.67,210.88 141.63,211.84 v1(143.5,211.84) ; H5#10.1 145.26,158.24 143.49,160.01 v1(143.49,161.43) 142.51,161.43 142.01,161.93 136.13,161.93 U6#8.29 ; CN1#22.7 33.27,23.14 33.49,22.92 39.58,22.92 40.54,23.88 v1(42.4,23.88) ; U6#27.29 35.04,237.11 40.92,237.11 41.41,236.61 v1(42.39,236.61) 42.39,235.2 44.17,233.43 H5#26.1